# Altium schematic sheet ReconProbe.SchDoc (part 1 of 2)
size 800 x 500 mm; SheetNumber: 1; SheetTotal: 2; SPICEModelCacheKXFRCMAS: <root> / <DocumentId>KXFRCMAS</DocumentId> / <CacheFrame Number="0"> / <Model Name="1206_156120vs82500p" Kind="CKT"> / <Text>****** / .subckt 1206_156120VS82500P  1  2 / D1 1 2 SMRW / .MODEL SMRW D / + IS=2.8896E-15 / + N=2.4166 / + RS=.90451 / + IKF=204.76E-6 / + CJO=1.0000E-12 / + M=.3333 / + VJ=.75 / + BV=5 / + IBV=100.00E-6 / + TT=5.0000E-9 / .ends</Text> / </Model> / </CacheFrame> / </root>
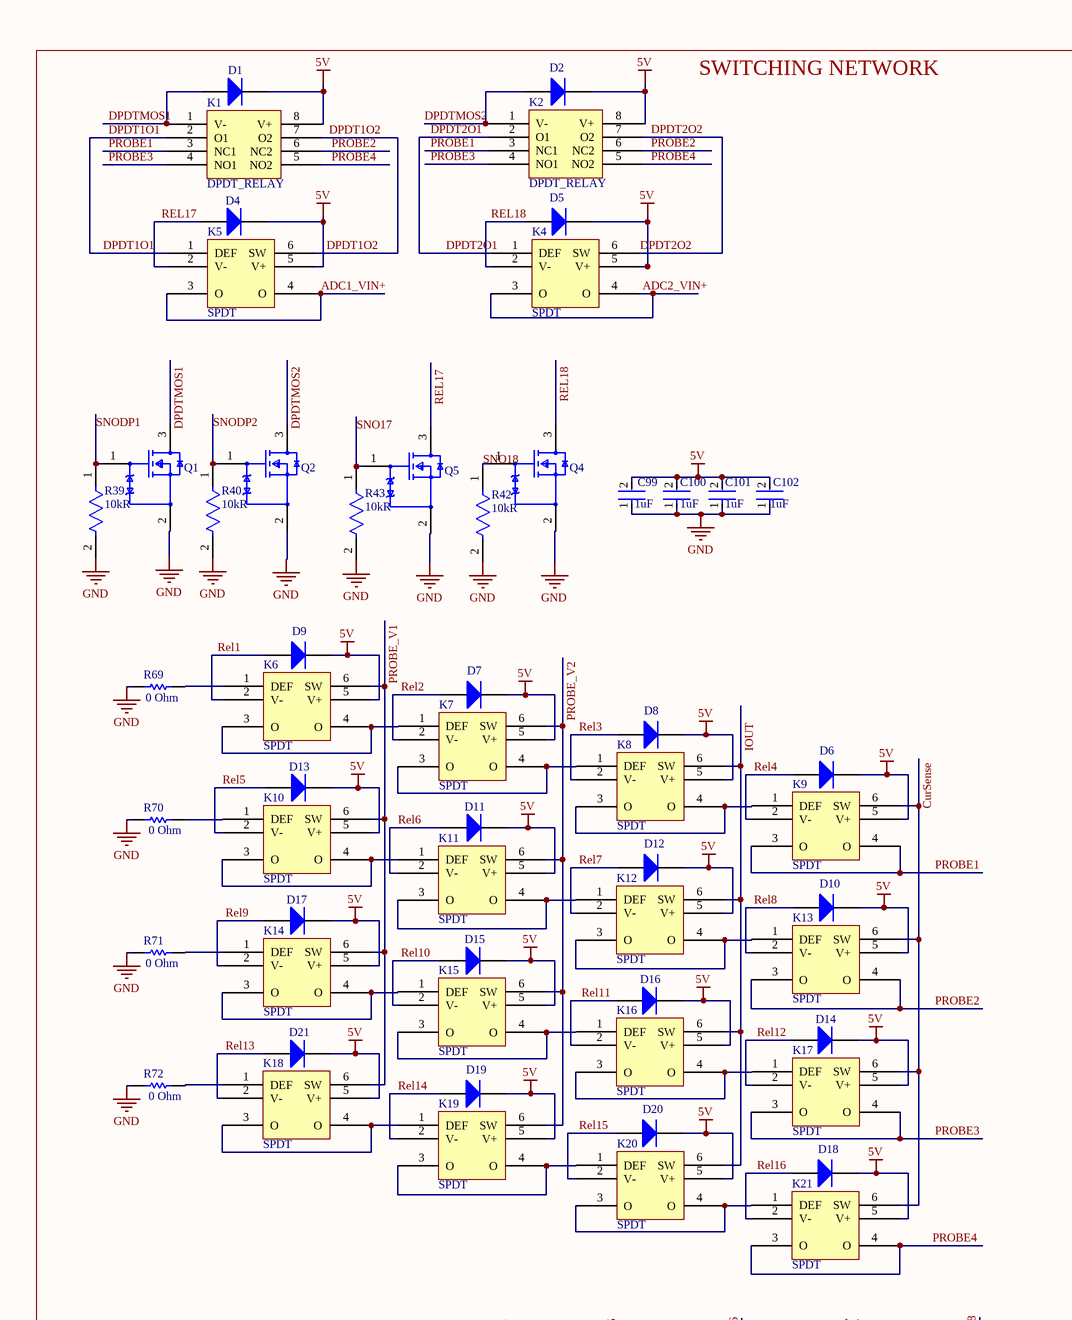
[diagram p0: ReconProbe.SchDoc, top left]
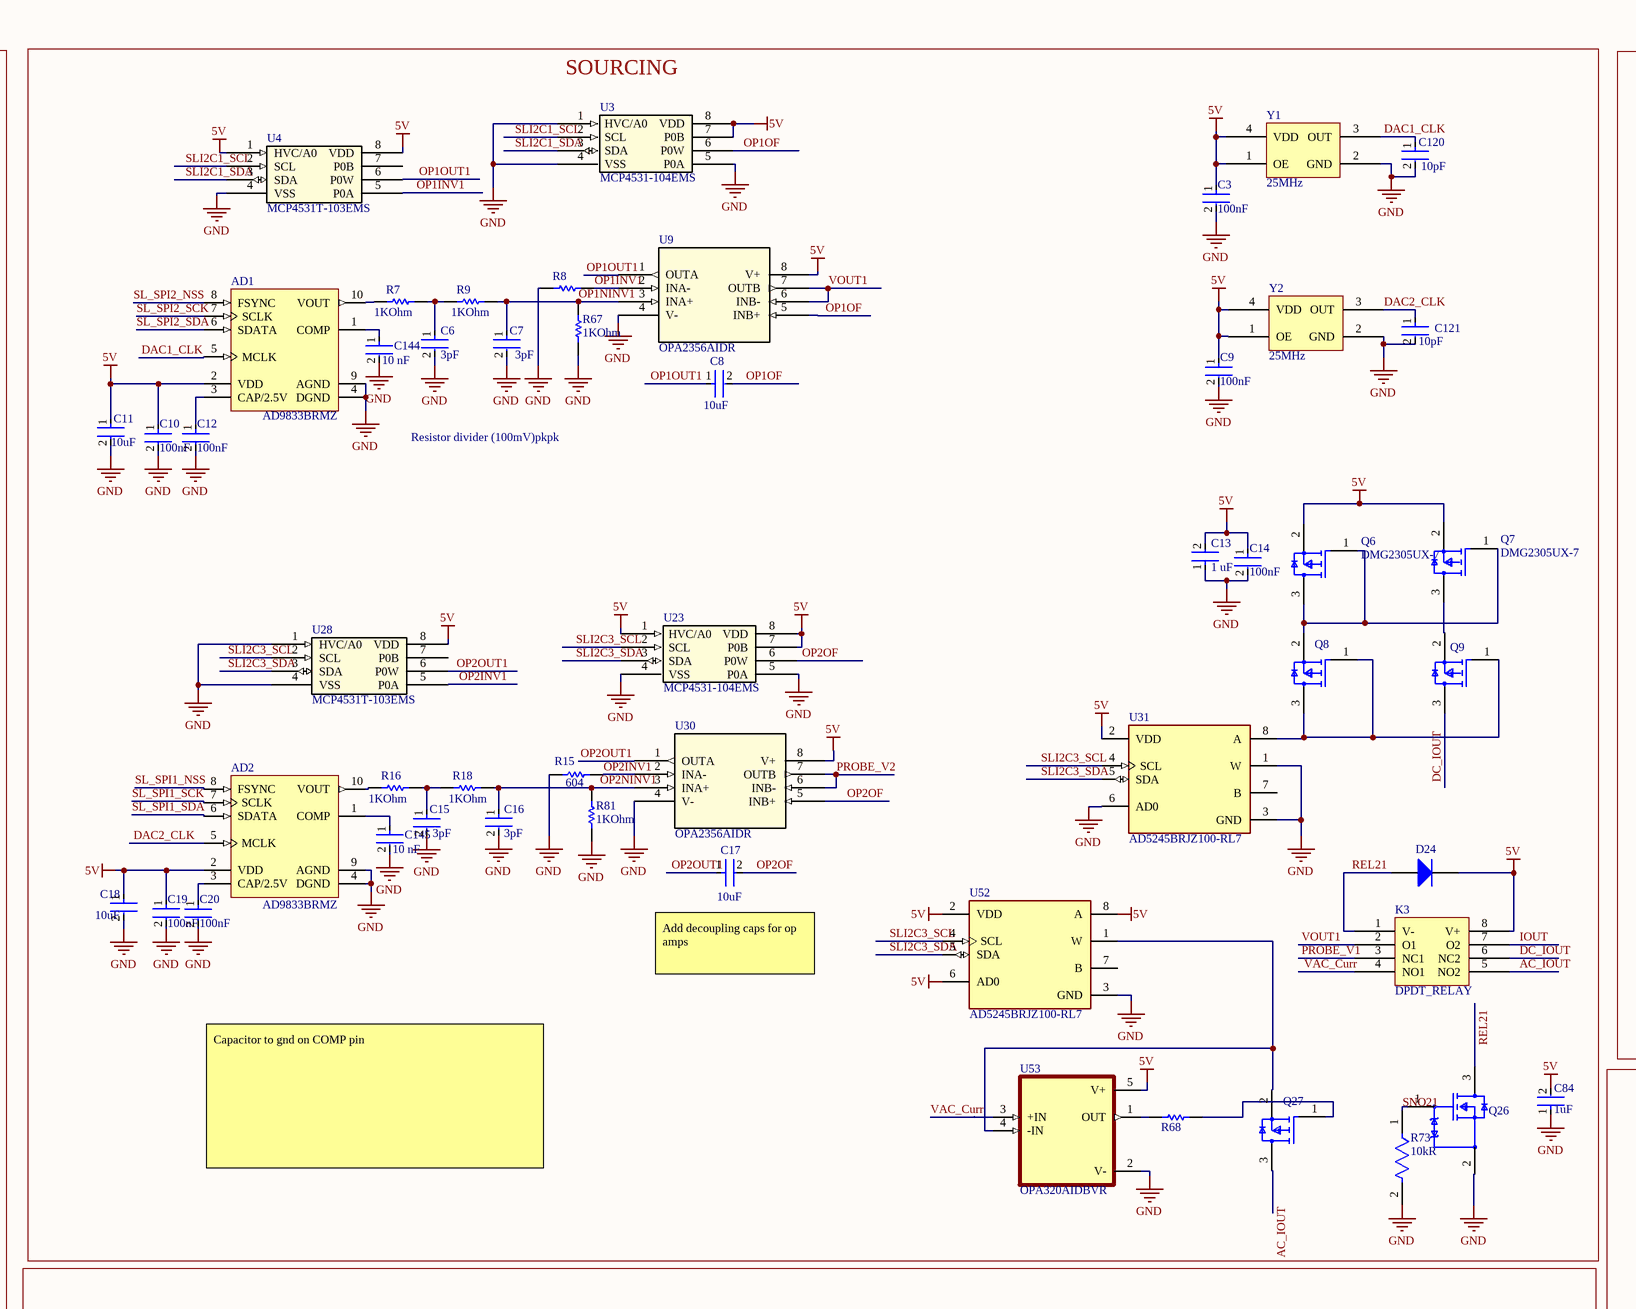
[diagram p1: ReconProbe.SchDoc, top middle]
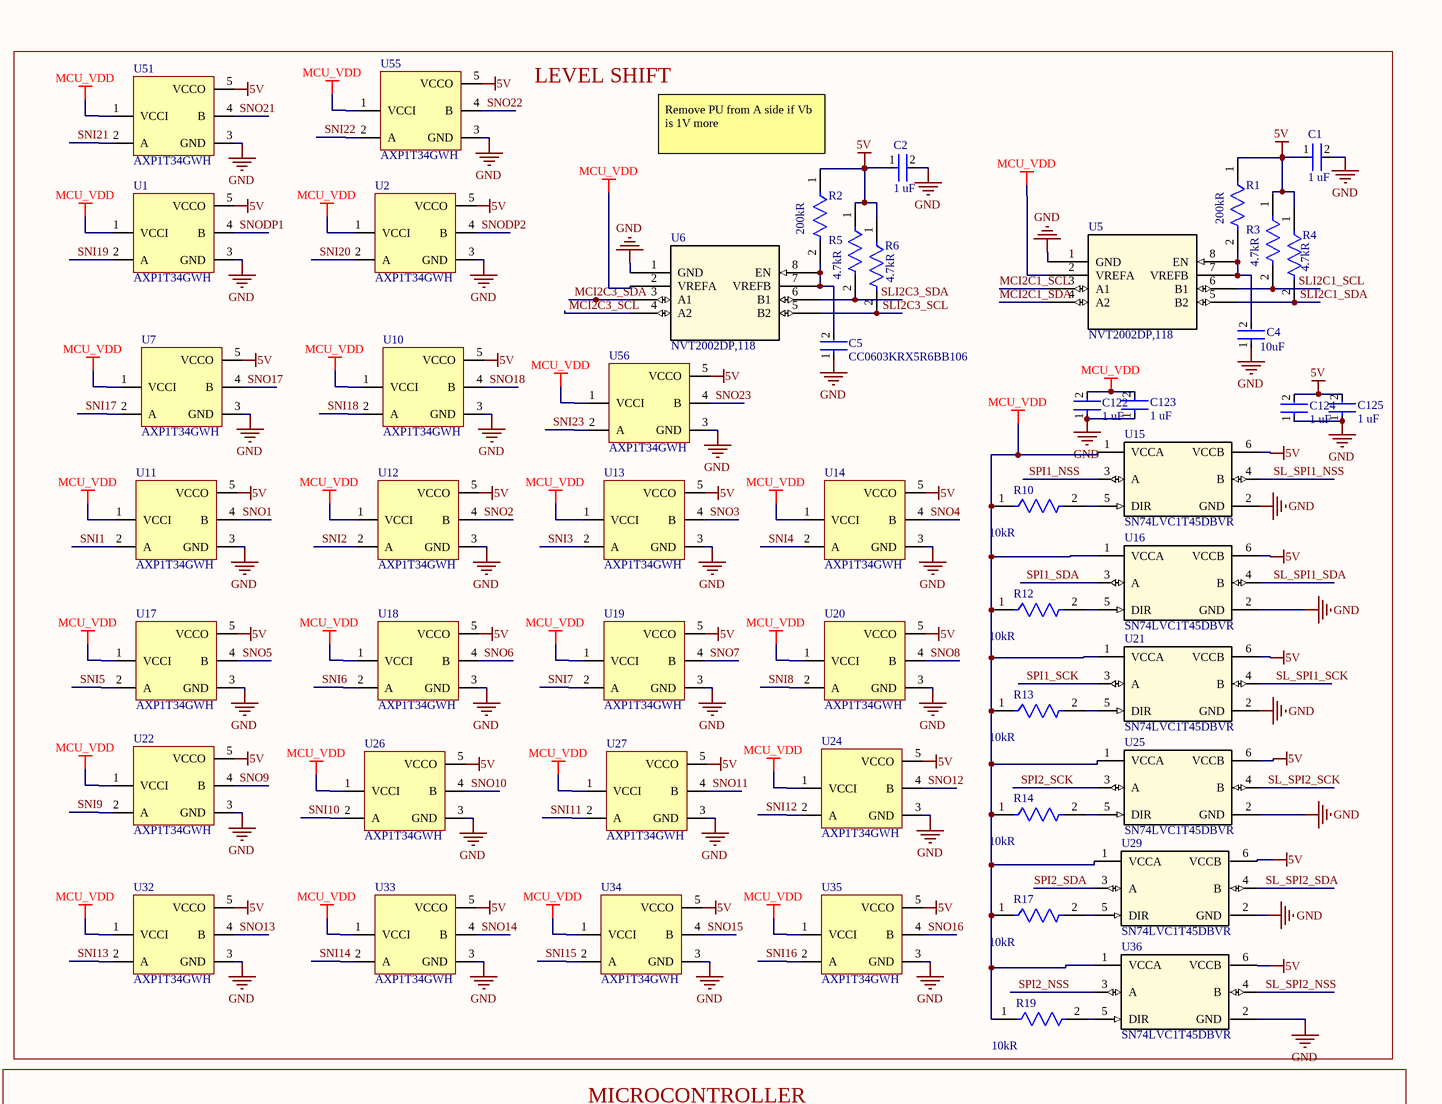
[diagram p2: ReconProbe.SchDoc, top right]
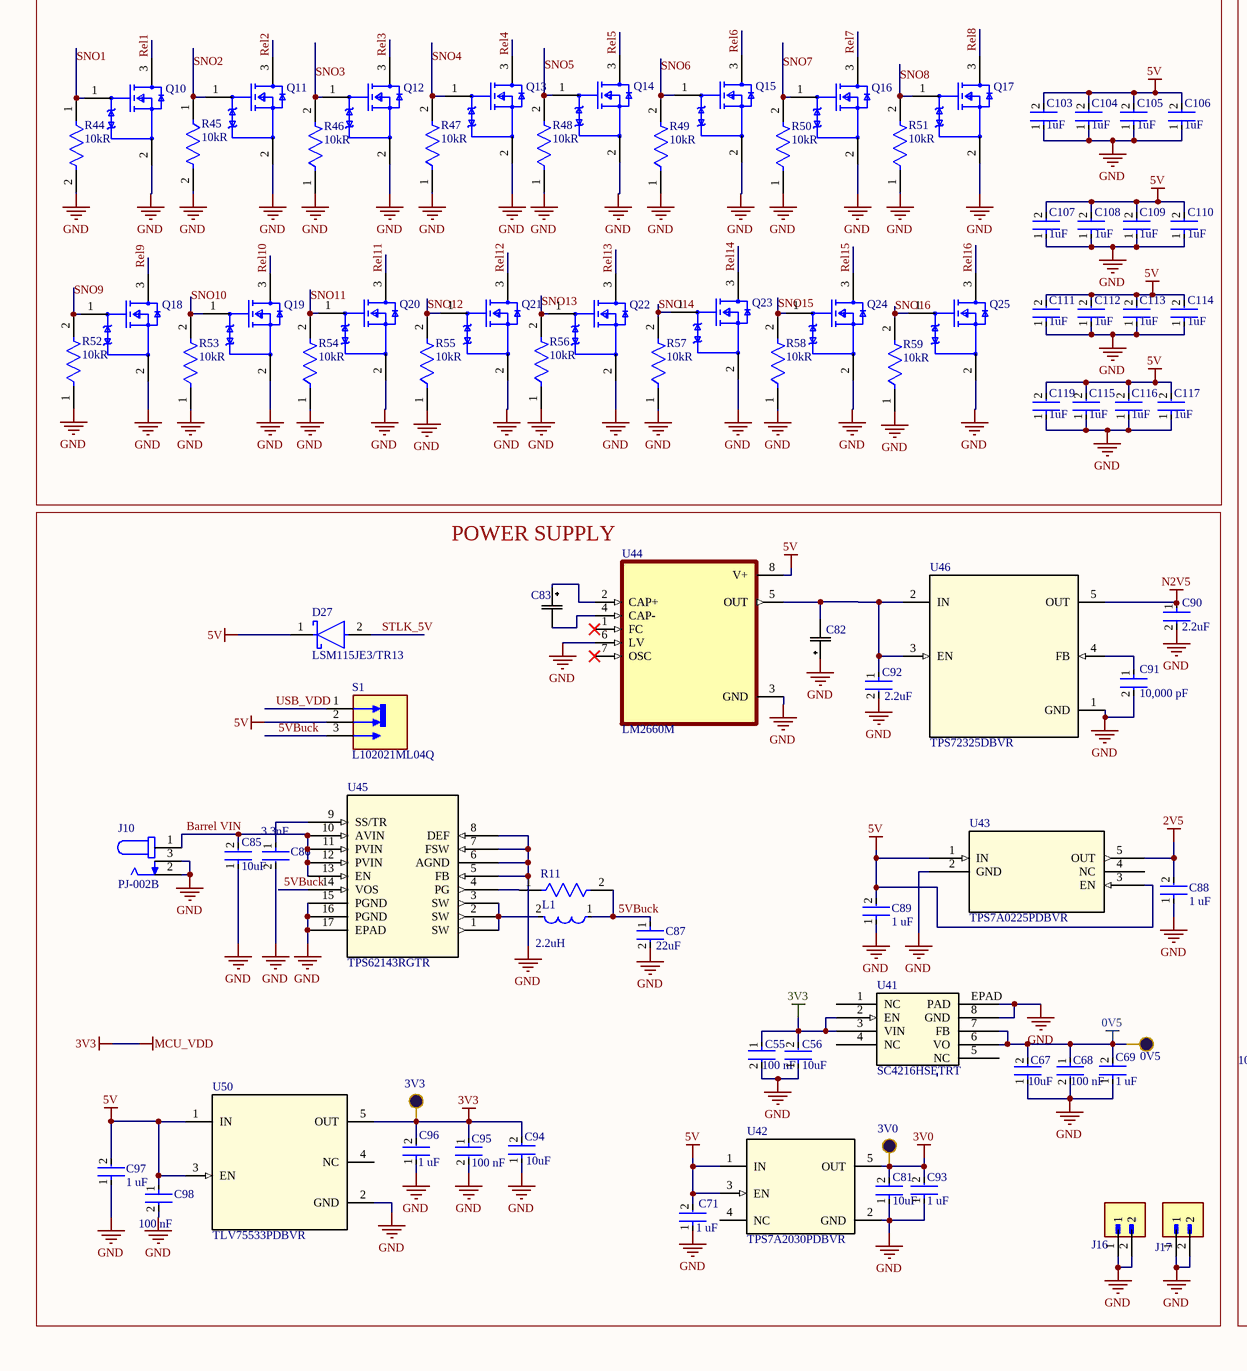
[diagram p3: ReconProbe.SchDoc, bottom left]
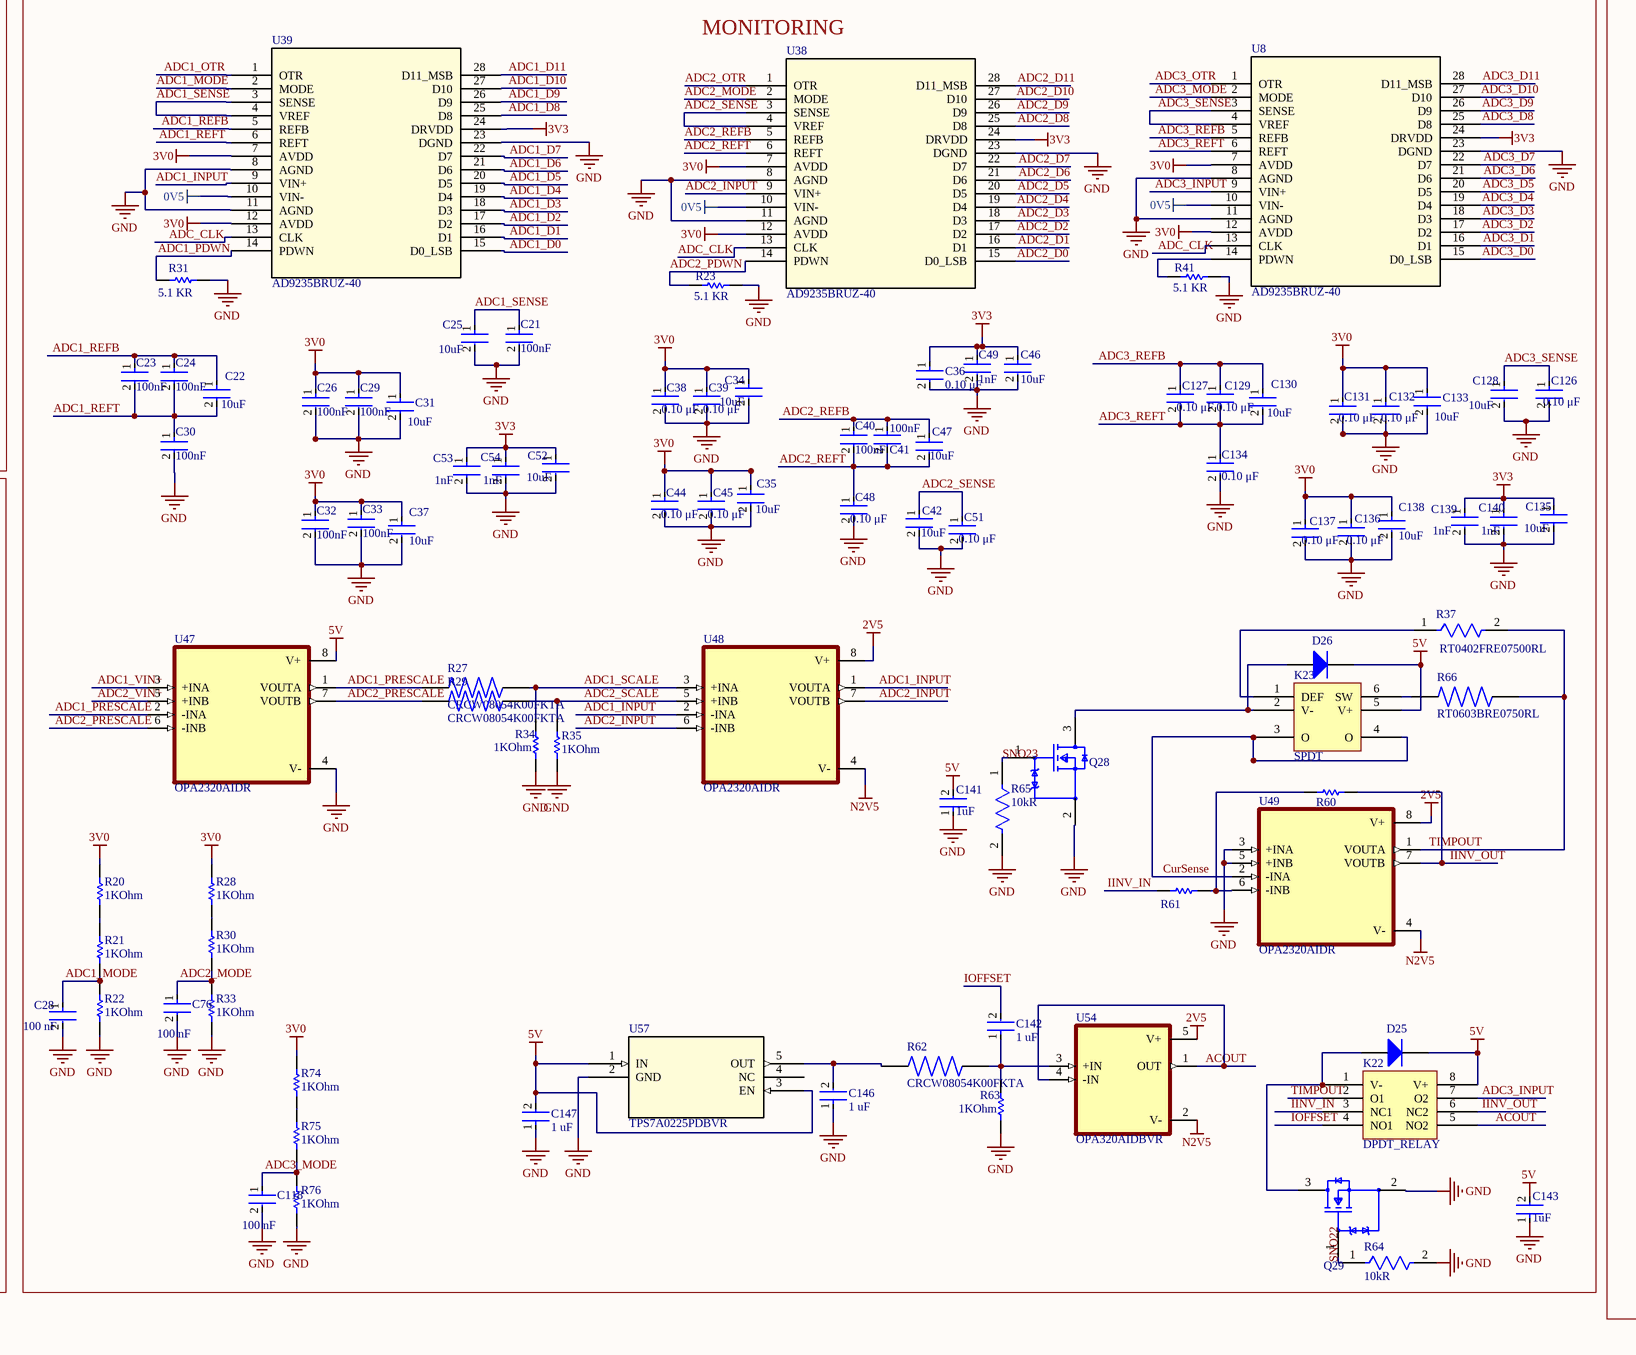
[diagram p4: ReconProbe.SchDoc, bottom middle]
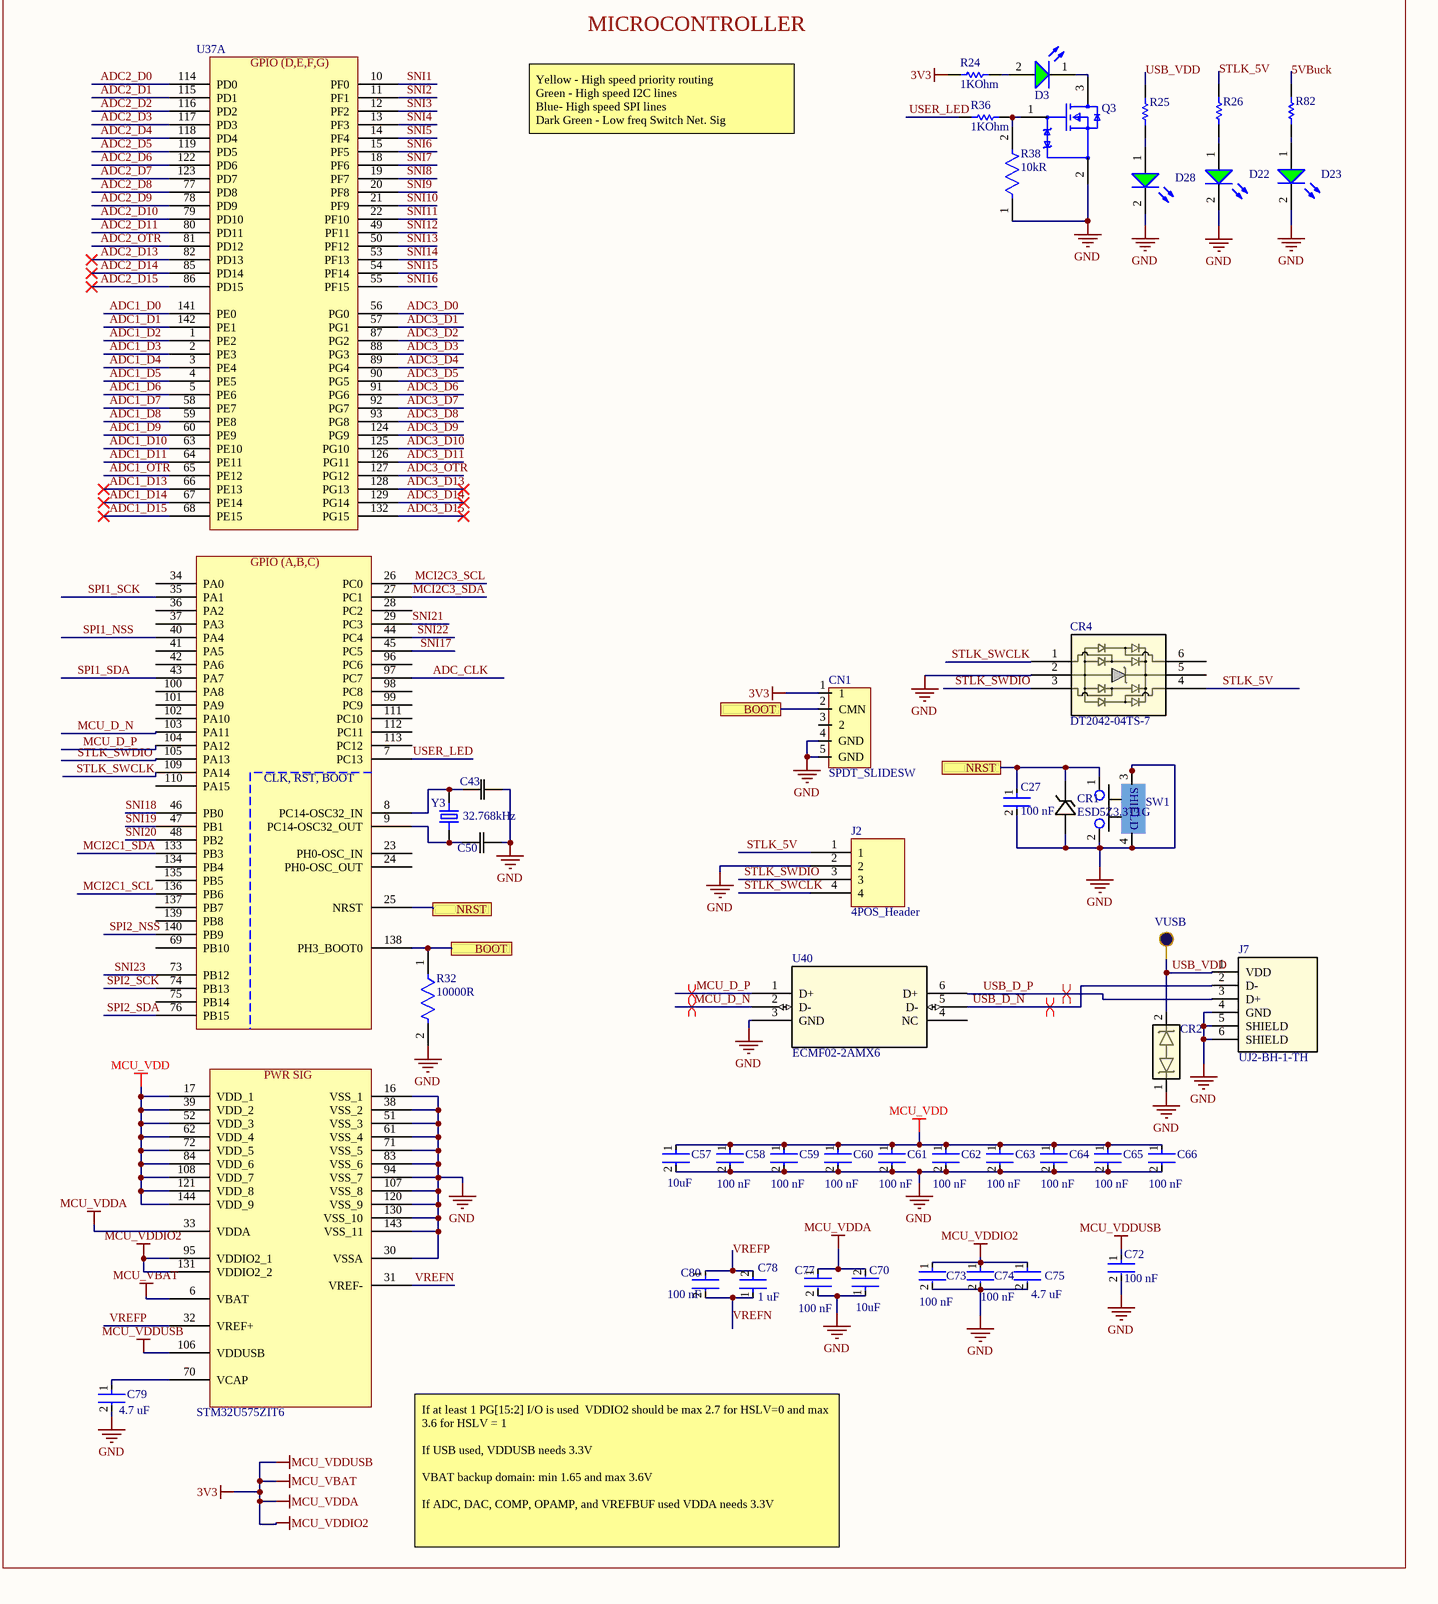
[diagram p5: ReconProbe.SchDoc, bottom right]

## Parts
0V5  1.10mm hole  [TestPoint_1.10mm]  (value not drawn)
3V0  1.10mm hole  [TestPoint_1.10mm]  (value not drawn)
3V3  1.10mm hole  [TestPoint_1.10mm]  (value not drawn)
AD1  AD9833BRMZ  [ADI-RM-10_M]
AD2  AD9833BRMZ  [ADI-RM-10_M]
C1  Capacitance: 1 uF  [FP-CC0805-0_85-MFG]  (hidden comment: CC0805KKX7R7BB105)
C2  Capacitance: 1 uF  [FP-CC0805-0_85-MFG]  (hidden comment: CC0805KKX7R7BB105)
C3  Capacitance: 100nF  [FP-C0402-BB-MFG]  (hidden comment: C0402C104K4RACTU)
C4  Capacitance: 10uF  [FP-CC0603-DC-MFG]  (hidden comment: CC0603KRX5R6BB106)
C5  CC0603KRX5R6BB106  [FP-CC0603-DC-MFG]
C6  Capacitance: 3pF  [FP-GJM155-0_05-IPC_A]  (hidden comment: GJM1555C1H3R0WB01D)
C7  Capacitance: 3pF  [FP-GJM155-0_05-IPC_A]  (hidden comment: GJM1555C1H3R0WB01D)
C8  Capacitance: 10uF  [FP-CC0603-DC-MFG]  (hidden comment: CC0603KRX5R6BB106)
C9  Capacitance: 100nF  [FP-C0402-BB-MFG]  (hidden comment: C0402C104K4RACTU)
C10  Capacitance: 100nF  [FP-C0402-BB-MFG]  (hidden comment: C0402C104K4RACTU)
C11  Capacitance: 10uF  [FP-CC0603-DC-MFG]  (hidden comment: CC0603KRX5R6BB106)
C12  Capacitance: 100nF  [FP-C0402-BB-MFG]  (hidden comment: C0402C104K4RACTU)
C13  Capacitance: 1 uF  [FP-CC0805-0_85-MFG]  (hidden comment: CC0805KKX7R7BB105)
C14  Capacitance: 100nF  [FP-C0402-BB-MFG]  (hidden comment: C0402C104K4RACTU)
C15  Capacitance: 3pF  [FP-GJM155-0_05-IPC_A]  (hidden comment: GJM1555C1H3R0WB01D)
C16  Capacitance: 3pF  [FP-GJM155-0_05-IPC_A]  (hidden comment: GJM1555C1H3R0WB01D)
C17  Capacitance: 10uF  [FP-CC0603-DC-MFG]  (hidden comment: CC0603KRX5R6BB106)
C18  Capacitance: 10uF  [FP-CC0603-DC-MFG]  (hidden comment: CC0603KRX5R6BB106)
C19  Capacitance: 100nF  [FP-C0402-BB-MFG]  (hidden comment: C0402C104K4RACTU)
C20  Capacitance: 100nF  [FP-C0402-BB-MFG]  (hidden comment: C0402C104K4RACTU)
C21  Capacitance: 100nF  [FP-C0402-BB-MFG]  (hidden comment: C0402C104K4RACTU)
C22  Capacitance: 10uF  [FP-CC0603-DC-MFG]  (hidden comment: CC0603KRX5R6BB106)
C23  Capacitance: 100nF  [FP-C0402-BB-MFG]  (hidden comment: C0402C104K4RACTU)
C24  Capacitance: 100nF  [FP-C0402-BB-MFG]  (hidden comment: C0402C104K4RACTU)
C25  Capacitance: 10uF  [FP-CC0603-DC-MFG]  (hidden comment: CC0603KRX5R6BB106)
C26  Capacitance: 100nF  [FP-C0402-BB-MFG]  (hidden comment: C0402C104K4RACTU)
C27  Capacitance: 100 nF  [FP-CC0402-MFG]  (hidden comment: CC0402KRX7R7BB104)
C28  Capacitance: 100 nF  [FP-CC0402-MFG]  (hidden comment: CC0402KRX7R7BB104)
C29  Capacitance: 100nF  [FP-C0402-BB-MFG]  (hidden comment: C0402C104K4RACTU)
C30  Capacitance: 100nF  [FP-C0402-BB-MFG]  (hidden comment: C0402C104K4RACTU)
C31  Capacitance: 10uF  [FP-CC0603-DC-MFG]  (hidden comment: CC0603KRX5R6BB106)
C32  Capacitance: 100nF  [FP-C0402-BB-MFG]  (hidden comment: C0402C104K4RACTU)
C33  Capacitance: 100nF  [FP-C0402-BB-MFG]  (hidden comment: C0402C104K4RACTU)
C34  Capacitance: 10uF  [FP-CC0603-DC-MFG]  (hidden comment: CC0603KRX5R6BB106)
C35  Capacitance: 10uF  [FP-CC0603-DC-MFG]  (hidden comment: CC0603KRX5R6BB106)
C36  Capacitance: 0.10 μF  [FP-C0402-BB-MFG]  (hidden comment: C0402C104K4RACTU)
C37  Capacitance: 10uF  [FP-CC0603-DC-MFG]  (hidden comment: CC0603KRX5R6BB106)
C38  Capacitance: 0.10 μF  [FP-C0402-BB-MFG]  (hidden comment: C0402C104K4RACTU)
C39  Capacitance: 0.10 μF  [FP-C0402-BB-MFG]  (hidden comment: C0402C104K4RACTU)
C40  Capacitance: 100nF  [FP-C0402-BB-MFG]  (hidden comment: C0402C104K4RACTU)
C41  Capacitance: 100nF  [FP-C0402-BB-MFG]  (hidden comment: C0402C104K4RACTU)
C42  Capacitance: 10uF  [FP-CC0603-DC-MFG]  (hidden comment: CC0603KRX5R6BB106)
C43  CC0805CRNPO9BN4R0  [CAP_CC0805_YAG]  (value not drawn)
C44  Capacitance: 0.10 μF  [FP-C0402-BB-MFG]  (hidden comment: C0402C104K4RACTU)
C45  Capacitance: 0.10 μF  [FP-C0402-BB-MFG]  (hidden comment: C0402C104K4RACTU)
C46  Capacitance: 10uF  [FP-CC0603-DC-MFG]  (hidden comment: CC0603KRX5R6BB106)
C47  Capacitance: 10uF  [FP-CC0603-DC-MFG]  (hidden comment: CC0603KRX5R6BB106)
C48  Capacitance: 0.10 μF  [FP-C0402-BB-MFG]  (hidden comment: C0402C104K4RACTU)
C49  Capacitance: 1nF  [FP-GRM155-0_05-IPC_B]  (hidden comment: GRM1555C1H102JA01D)
C50  CC0805CRNPO9BN4R0  [CAP_CC0805_YAG]  (value not drawn)
C51  Capacitance: 0.10 μF  [FP-C0402-BB-MFG]  (hidden comment: C0402C104K4RACTU)
C52  Capacitance: 10uF  [FP-CC0603-DC-MFG]  (hidden comment: CC0603KRX5R6BB106)
C53  Capacitance: 1nF  [FP-GRM155-0_05-IPC_B]  (hidden comment: GRM1555C1H102JA01D)
C54  Capacitance: 1nF  [FP-GRM155-0_05-IPC_B]  (hidden comment: GRM1555C1H102JA01D)
C55  Capacitance: 100 nF  [FP-CC0402-MFG]  (hidden comment: CC0402KRX7R7BB104)
C56  Capacitance: 10uF  [FP-CC0603-DC-MFG]  (hidden comment: CC0603KRX5R6BB106)
C57  Capacitance: 10uF  [FP-CC0603-DC-MFG]  (hidden comment: CC0603KRX5R6BB106)
C58  Capacitance: 100 nF  [FP-CC0402-MFG]  (hidden comment: CC0402KRX7R7BB104)
C59  Capacitance: 100 nF  [FP-CC0402-MFG]  (hidden comment: CC0402KRX7R7BB104)
C60  Capacitance: 100 nF  [FP-CC0402-MFG]  (hidden comment: CC0402KRX7R7BB104)
C61  Capacitance: 100 nF  [FP-CC0402-MFG]  (hidden comment: CC0402KRX7R7BB104)
C62  Capacitance: 100 nF  [FP-CC0402-MFG]  (hidden comment: CC0402KRX7R7BB104)
C63  Capacitance: 100 nF  [FP-CC0402-MFG]  (hidden comment: CC0402KRX7R7BB104)
C64  Capacitance: 100 nF  [FP-CC0402-MFG]  (hidden comment: CC0402KRX7R7BB104)
C65  Capacitance: 100 nF  [FP-CC0402-MFG]  (hidden comment: CC0402KRX7R7BB104)
C66  Capacitance: 100 nF  [FP-CC0402-MFG]  (hidden comment: CC0402KRX7R7BB104)
C67  Capacitance: 10uF  [FP-CC0603-DC-MFG]  (hidden comment: CC0603KRX5R6BB106)
C68  Capacitance: 100 nF  [FP-CC0402-MFG]  (hidden comment: CC0402KRX7R7BB104)
C69  Capacitance: 1 uF  [FP-CC0805-0_85-MFG]  (hidden comment: CC0805KKX7R7BB105)
C70  Capacitance: 10uF  [FP-CC0603-DC-MFG]  (hidden comment: CC0603KRX5R6BB106)
C71  Capacitance: 1 uF  [FP-CC0805-0_85-MFG]  (hidden comment: CC0805KKX7R7BB105)
C72  Capacitance: 100 nF  [FP-CC0402-MFG]  (hidden comment: CC0402KRX7R7BB104)
C73  Capacitance: 100 nF  [FP-CC0402-MFG]  (hidden comment: CC0402KRX7R7BB104)
C74  Capacitance: 100 nF  [FP-CC0402-MFG]  (hidden comment: CC0402KRX7R7BB104)
C75  Capacitance: 4.7 uF  [FP-CC0603-DA-MFG]  (hidden comment: CC0603KRX5R7BB475)
C76  Capacitance: 100 nF  [FP-CC0402-MFG]  (hidden comment: CC0402KRX7R7BB104)
C77  Capacitance: 100 nF  [FP-CC0402-MFG]  (hidden comment: CC0402KRX7R7BB104)
C78  Capacitance: 1 uF  [FP-CC0805-0_85-MFG]  (hidden comment: CC0805KKX7R7BB105)
C79  Capacitance: 4.7 uF  [FP-CC0603-DA-MFG]  (hidden comment: CC0603KRX5R7BB475)
C80  Capacitance: 100 nF  [FP-CC0402-MFG]  (hidden comment: CC0402KRX7R7BB104)
C81  Capacitance: 10uF  [FP-CC0603-DC-MFG]  (hidden comment: CC0603KRX5R6BB106)
C82  RHA1C151MCN1GS  [CAP_RHAHS_8X6P7_NCH]  (value not drawn)
C83  RHA1C151MCN1GS  [CAP_RHAHS_8X6P7_NCH]  (value not drawn)
C84  Capacitance: 1uF  [FP-CL21-IPC_C]  (hidden comment: CL21B105KBFNNNG)
C85  Capacitance: 10uF  [FP-CC0603-DC-MFG]  (hidden comment: CC0603KRX5R6BB106)
C86  Capacitance: 3.3nF  [FP-GRM188-0_1-e0_2_0_5-IPC_A]  (hidden comment: GRM1885C1H332JA01D)
C87  Capacitance: 22uF  [FP-CL21-IPC_C]  (hidden comment: CL21A226MAYNNNE)
C88  Capacitance: 1 uF  [FP-CC0805-0_85-MFG]  (hidden comment: CC0805KKX7R7BB105)
C89  Capacitance: 1 uF  [FP-CC0805-0_85-MFG]  (hidden comment: CC0805KKX7R7BB105)
C90  Capacitance: 2.2uF  [FP-C2012-125-0_2-MFG]  (hidden comment: C2012X7R1C225K125AB)
C91  Capacitance: 10,000 pF  [FP-C0805C-DN-MFG]  (hidden comment: C0805C103K5RACTU)
C92  Capacitance: 2.2uF  [FP-C2012-125-0_2-MFG]  (hidden comment: C2012X7R1C225K125AB)
C93  Capacitance: 1 uF  [FP-CC0805-0_85-MFG]  (hidden comment: CC0805KKX7R7BB105)
C94  Capacitance: 10uF  [FP-CC0603-DC-MFG]  (hidden comment: CC0603KRX5R6BB106)
C95  Capacitance: 100 nF  [FP-CC0402-MFG]  (hidden comment: CC0402KRX7R7BB104)
C96  Capacitance: 1 uF  [FP-CC0805-0_85-MFG]  (hidden comment: CC0805KKX7R7BB105)
C97  Capacitance: 1 uF  [FP-CC0805-0_85-MFG]  (hidden comment: CC0805KKX7R7BB105)
C98  Capacitance: 100 nF  [FP-CC0402-MFG]  (hidden comment: CC0402KRX7R7BB104)
C99  Capacitance: 1uF  [FP-CL21-IPC_C]  (hidden comment: CL21B105KBFNNNG)
C100  Capacitance: 1uF  [FP-CL21-IPC_C]  (hidden comment: CL21B105KBFNNNG)
C101  Capacitance: 1uF  [FP-CL21-IPC_C]  (hidden comment: CL21B105KBFNNNG)
C102  Capacitance: 1uF  [FP-CL21-IPC_C]  (hidden comment: CL21B105KBFNNNG)
C103  Capacitance: 1uF  [FP-CL21-IPC_C]  (hidden comment: CL21B105KBFNNNG)
C104  Capacitance: 1uF  [FP-CL21-IPC_C]  (hidden comment: CL21B105KBFNNNG)
C105  Capacitance: 1uF  [FP-CL21-IPC_C]  (hidden comment: CL21B105KBFNNNG)
C106  Capacitance: 1uF  [FP-CL21-IPC_C]  (hidden comment: CL21B105KBFNNNG)
C107  Capacitance: 1uF  [FP-CL21-IPC_C]  (hidden comment: CL21B105KBFNNNG)
C108  Capacitance: 1uF  [FP-CL21-IPC_C]  (hidden comment: CL21B105KBFNNNG)
C109  Capacitance: 1uF  [FP-CL21-IPC_C]  (hidden comment: CL21B105KBFNNNG)
C110  Capacitance: 1uF  [FP-CL21-IPC_C]  (hidden comment: CL21B105KBFNNNG)
C111  Capacitance: 1uF  [FP-CL21-IPC_C]  (hidden comment: CL21B105KBFNNNG)
C112  Capacitance: 1uF  [FP-CL21-IPC_C]  (hidden comment: CL21B105KBFNNNG)
C113  Capacitance: 1uF  [FP-CL21-IPC_C]  (hidden comment: CL21B105KBFNNNG)
C114  Capacitance: 1uF  [FP-CL21-IPC_C]  (hidden comment: CL21B105KBFNNNG)
C115  Capacitance: 1uF  [FP-CL21-IPC_C]  (hidden comment: CL21B105KBFNNNG)
C116  Capacitance: 1uF  [FP-CL21-IPC_C]  (hidden comment: CL21B105KBFNNNG)
C117  Capacitance: 1uF  [FP-CL21-IPC_C]  (hidden comment: CL21B105KBFNNNG)
C118  Capacitance: 100 nF  [FP-CC0402-MFG]  (hidden comment: CC0402KRX7R7BB104)
C119  Capacitance: 1uF  [FP-CL21-IPC_C]  (hidden comment: CL21B105KBFNNNG)
C120  Capacitance: 10pF  [FP-GJM155-0_05-IPC_B]  (hidden comment: GJM1555C1H100GB01D)
C121  Capacitance: 10pF  [FP-GJM155-0_05-IPC_B]  (hidden comment: GJM1555C1H100GB01D)
C122  Capacitance: 1 uF  [FP-CC0805-0_85-MFG]  (hidden comment: CC0805KKX7R7BB105)
C123  Capacitance: 1 uF  [FP-CC0805-0_85-MFG]  (hidden comment: CC0805KKX7R7BB105)